# EasyEDA Pro project URADORRY-SUN1.2.eprj, schematic Sub - ATmega32U4(1.2)
Create Date: 2024-06-10; Page Name: base; Project Name: URADORRY-SUN; Schematic Name: Sub - ATmega32U4(1.2); Update Date: 2024-06-11; Add into BOM: yes; Company: 整数71の情報処理; Convert to PCB: yes; Drawed: 整数71
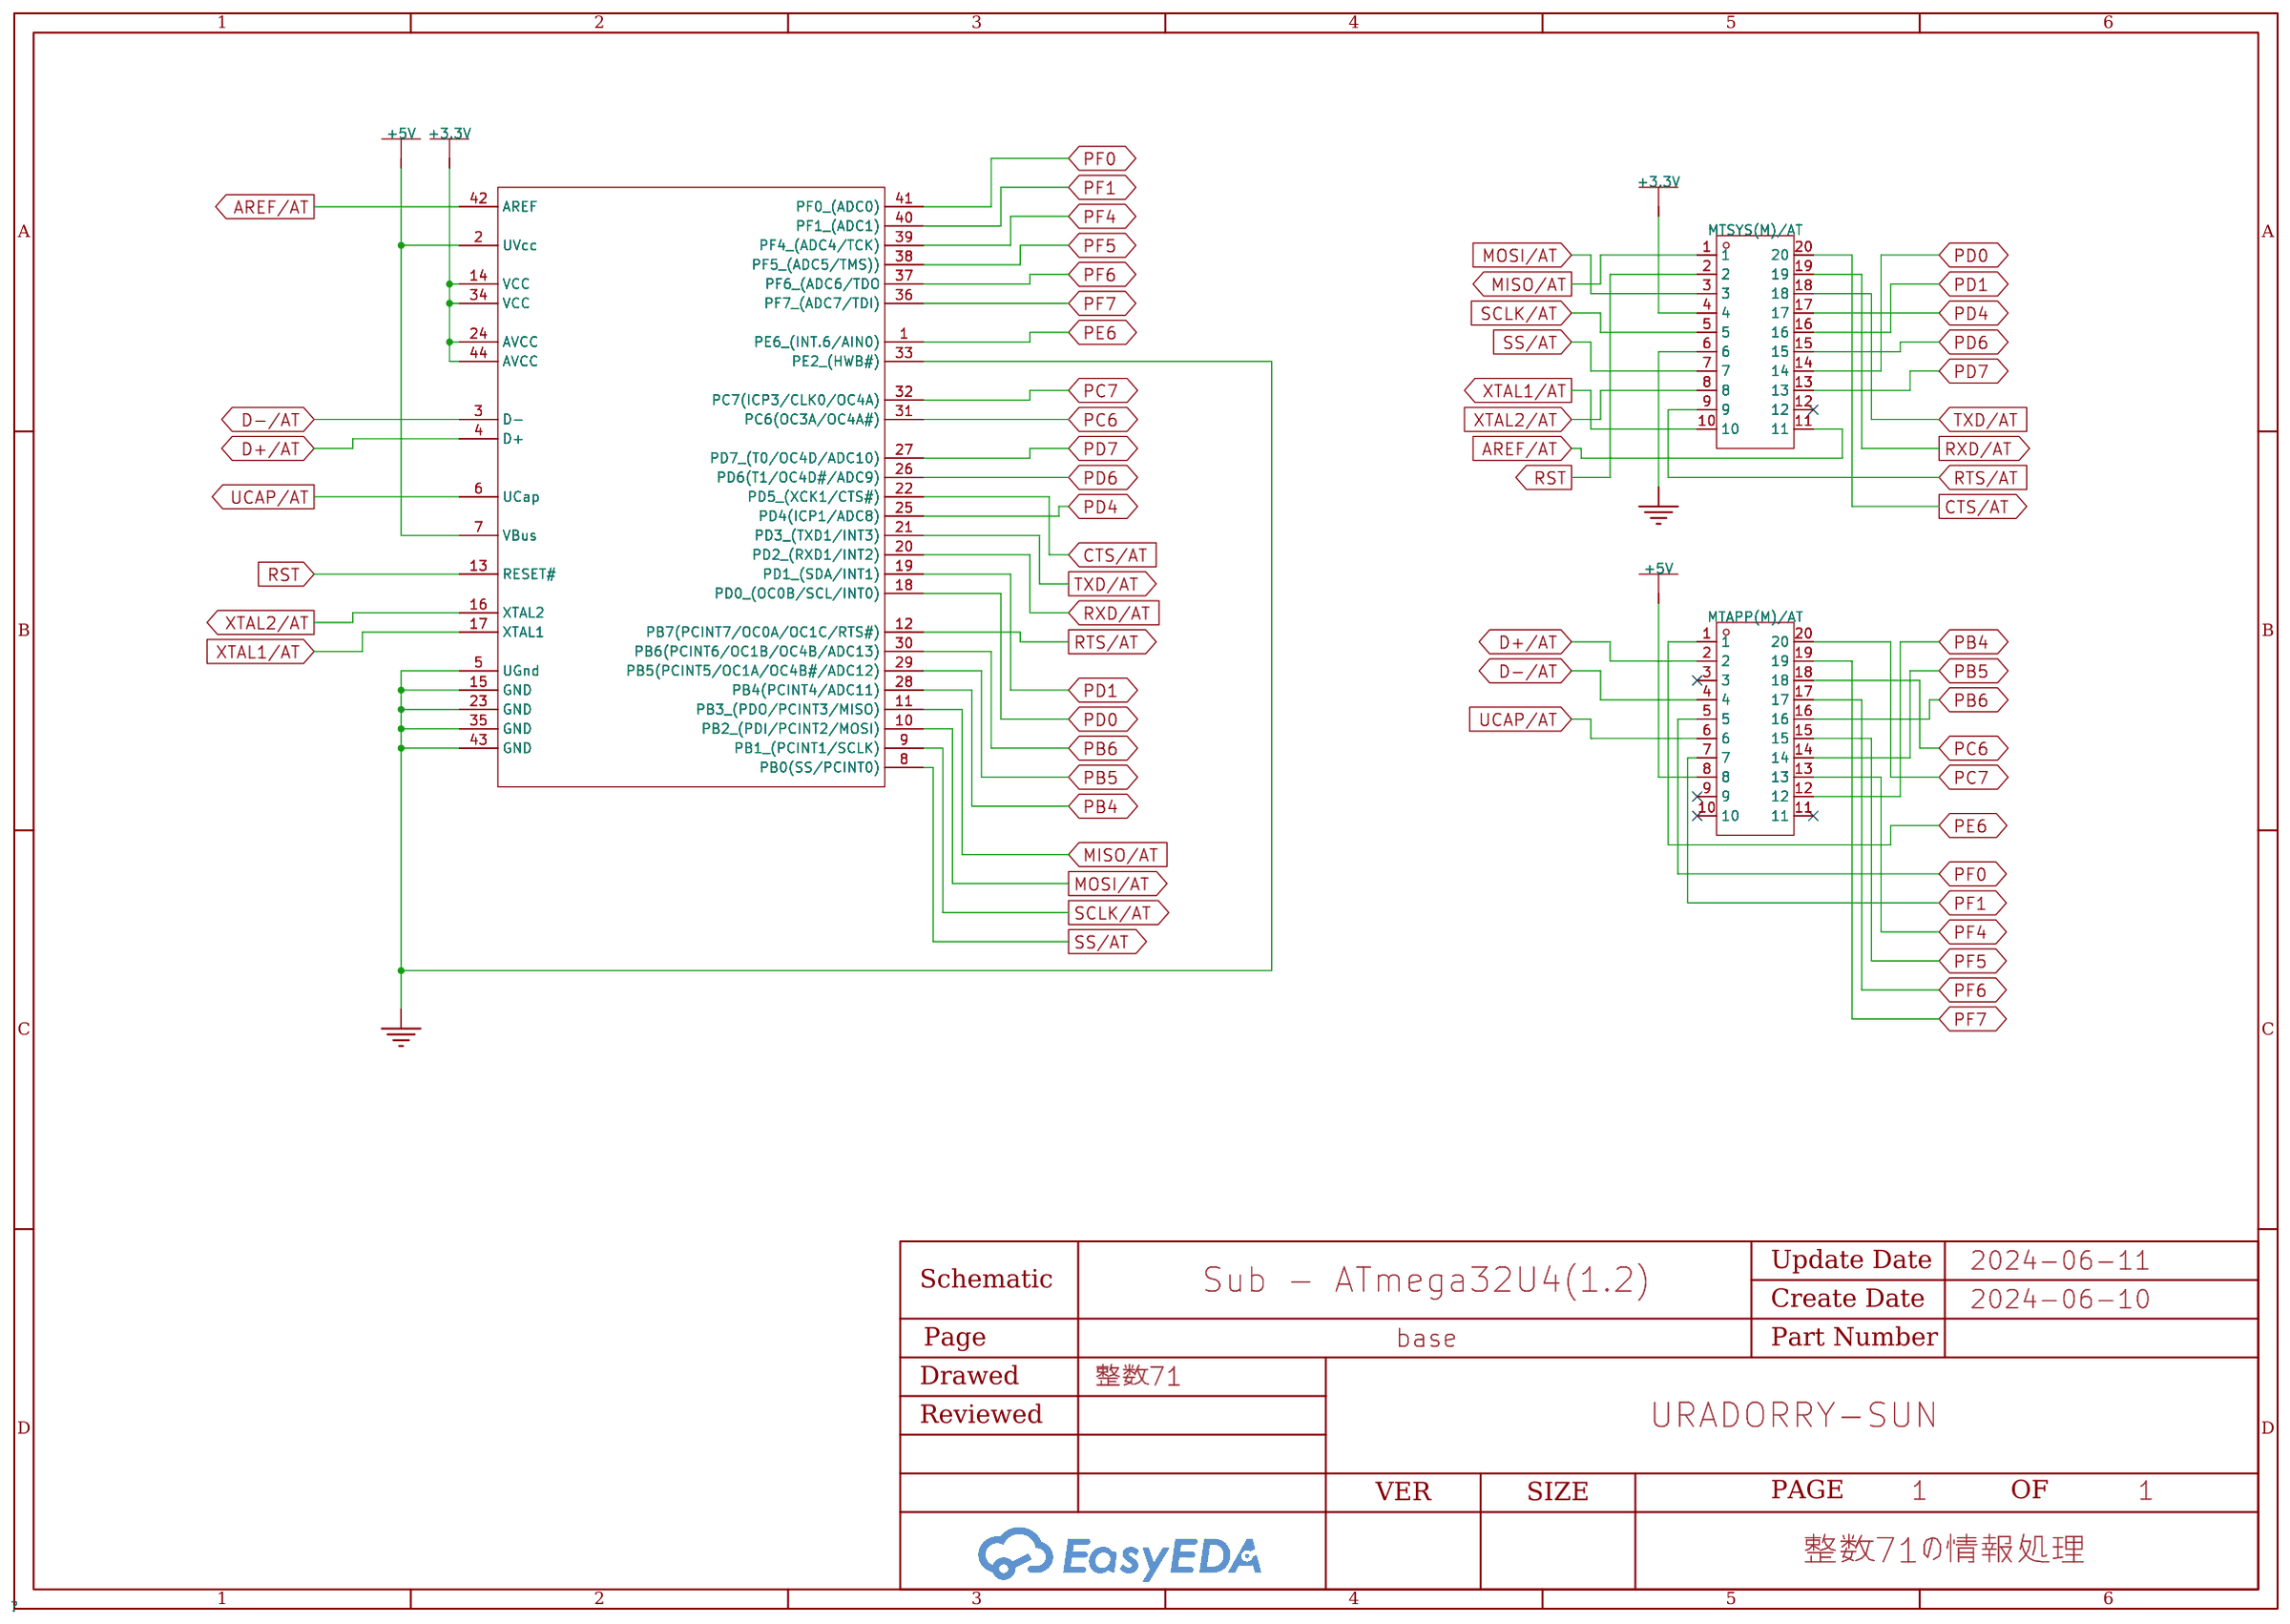
[diagram p1: schematic sheet]

## Parts
ATmega32U4  ATMEGA32U4-AU  [QFP-44_L10.0-W10.0-P0.80-LS13.2-BL]
MTAPP(M)/AT  AXK6F20547YG  [CONN-SMD_20P-P0.50_C2917022]
MTSYS(M)/AT  AXK6F20547YG  [CONN-SMD_20P-P0.50_C2917022]

## Library data of the parts
ATmega32U4 = ATMEGA32U4-AU: CPU Core:AVR Program Storage Size:32KB RAM Size:2.5KB GPIO Ports Number:26 Operating Voltage Range:2.7V~5.5V Operating Voltage Range:2.7V~5.5V CPU Maximum Speed:16MHz Program Memory Type:FLASH EEPROM:1KB Operating Temperature Range:-40℃~+85℃ Operating Tem; Supplier Part: C44854; Manufacturer: MICROCHIP(美国微芯); Supplier Footprint: QFP-44(10x10); JLCPCB Part Class: Extended Part; Datasheet: https://atta.szlcsc.com/upload/public/pdf/source/20150407/1457707275091.pdf; Supplier: LCSC; CPU Core: AVR; Program Storage Size: 32KB; RAM Size: 2.5KB; GPIO Ports Number: 26; Operating Voltage Range: 2.7V~5.5V; CPU Maximum Speed: 16MHz; Program Memory Type: FLASH; EEPROM: 1KB; Operating Temperature Range: -40℃~+85℃; ADC (Bit): 10bit; Universal Serial Bus: 有; Peripheral/Function: WDT；PWM; Watchdog: 有; Low-Voltage Detect: 有; Internal Oscillator: 有; Check: true
MTAPP(M)/AT MTSYS(M)/AT = Mezzanine(20M) - SMD0.5mm: Number of Pins:- Pitch:0.5mm Gender:公 Mounting Style:Brick nogging Number of Rows:2 Contact Plating:Gold; LCSC Part Name: 间距:0.5mm 公 立贴; Supplier Part: C2917022; Manufacturer: PANASONIC(松下); Supplier Footprint: SMD,P=0.5mm; JLCPCB Part Class: Extended Part; Datasheet: https://atta.szlcsc.com/upload/public/pdf/source/20220311/6F5DC41F043C9CF6954EB51995931AE2.pdf; Supplier: LCSC; Pitch: 0.5mm; Gender: 公; Mounting Style: Brick nogging; Number of Rows: 2; Contact Plating: Gold

## Nets
+3.3V: ATmega32U4.14(VCC) ATmega32U4.24(AVCC) ATmega32U4.34(VCC) ATmega32U4.44(AVCC) MTSYS(M)/AT.4
+5V: ATmega32U4.2(UVcc) ATmega32U4.7(VBus) MTAPP(M)/AT.8
GND: ATmega32U4.5(UGnd) ATmega32U4.15(GND) ATmega32U4.23(GND) ATmega32U4.33(PE2 (HWB#)) ATmega32U4.35(GND) ATmega32U4.43(GND) MTSYS(M)/AT.6
AREF/AT: ATmega32U4.42(AREF) MTSYS(M)/AT.11
CTS/AT: ATmega32U4.22(PD5 (XCK1/CTS#)) MTSYS(M)/AT.20
D+/AT: ATmega32U4.4(D+) MTAPP(M)/AT.2
D-/AT: ATmega32U4.3(D-) MTAPP(M)/AT.4
MISO/AT: ATmega32U4.11(PB3 (PDO/PCINT3/MISO)) MTSYS(M)/AT.1
MOSI/AT: ATmega32U4.10(PB2 (PDI/PCINT2/MOSI)) MTSYS(M)/AT.3
PB4: ATmega32U4.28(PB4(PCINT4/ADC11)) MTAPP(M)/AT.12
PB5: ATmega32U4.29(PB5(PCINT5/OC1A/OC4B#/ADC12)) MTAPP(M)/AT.14
PB6: ATmega32U4.30(PB6(PCINT6/OC1B/OC4B/ADC13)) MTAPP(M)/AT.16
PC6: ATmega32U4.31(PC6(OC3A/OC4A#)) MTAPP(M)/AT.18
PC7: ATmega32U4.32(PC7(ICP3/CLK0/OC4A)) MTAPP(M)/AT.20
PD0: ATmega32U4.18(PD0 (OC0B/SCL/INT0)) MTSYS(M)/AT.14
PD1: ATmega32U4.19(PD1 (SDA/INT1)) MTSYS(M)/AT.16
PD4: ATmega32U4.25(PD4(ICP1/ADC8)) MTSYS(M)/AT.17
PD6: ATmega32U4.26(PD6(T1/OC4D#/ADC9)) MTSYS(M)/AT.15
PD7: ATmega32U4.27(PD7 (T0/OC4D/ADC10)) MTSYS(M)/AT.13
PE6: ATmega32U4.1(PE6 (INT.6/AIN0)) MTAPP(M)/AT.1
PF0: ATmega32U4.41(PF0 (ADC0)) MTAPP(M)/AT.5
PF1: ATmega32U4.40(PF1 (ADC1)) MTAPP(M)/AT.7
PF4: ATmega32U4.39(PF4 (ADC4/TCK)) MTAPP(M)/AT.13
PF5: ATmega32U4.38(PF5 (ADC5/TMS))) MTAPP(M)/AT.15
PF6: ATmega32U4.37(PF6 (ADC6/TDO) MTAPP(M)/AT.17
PF7: ATmega32U4.36(PF7 (ADC7/TDI)) MTAPP(M)/AT.19
RST: ATmega32U4.13(RESET#) MTSYS(M)/AT.2
RTS/AT: ATmega32U4.12(PB7(PCINT7/OC0A/OC1C/RTS#)) MTSYS(M)/AT.9
RXD/AT: ATmega32U4.20(PD2 (RXD1/INT2)) MTSYS(M)/AT.19
SCLK/AT: ATmega32U4.9(PB1 (PCINT1/SCLK)) MTSYS(M)/AT.5
SS/AT: ATmega32U4.8(PB0(SS/PCINT0)) MTSYS(M)/AT.7
TXD/AT: ATmega32U4.21(PD3 (TXD1/INT3)) MTSYS(M)/AT.18
UCAP/AT: ATmega32U4.6(UCap) MTAPP(M)/AT.6
XTAL1/AT: ATmega32U4.17(XTAL1) MTSYS(M)/AT.10
XTAL2/AT: ATmega32U4.16(XTAL2) MTSYS(M)/AT.8

Not connected (* = marked no-connect by the designer): MTAPP(M)/AT 3* 9* 10* 11*; MTSYS(M)/AT 12*
